# EasyEDA Pro project ProProject_Avaota Pi A_2024-03-25.epro, board PCB1 (continued)
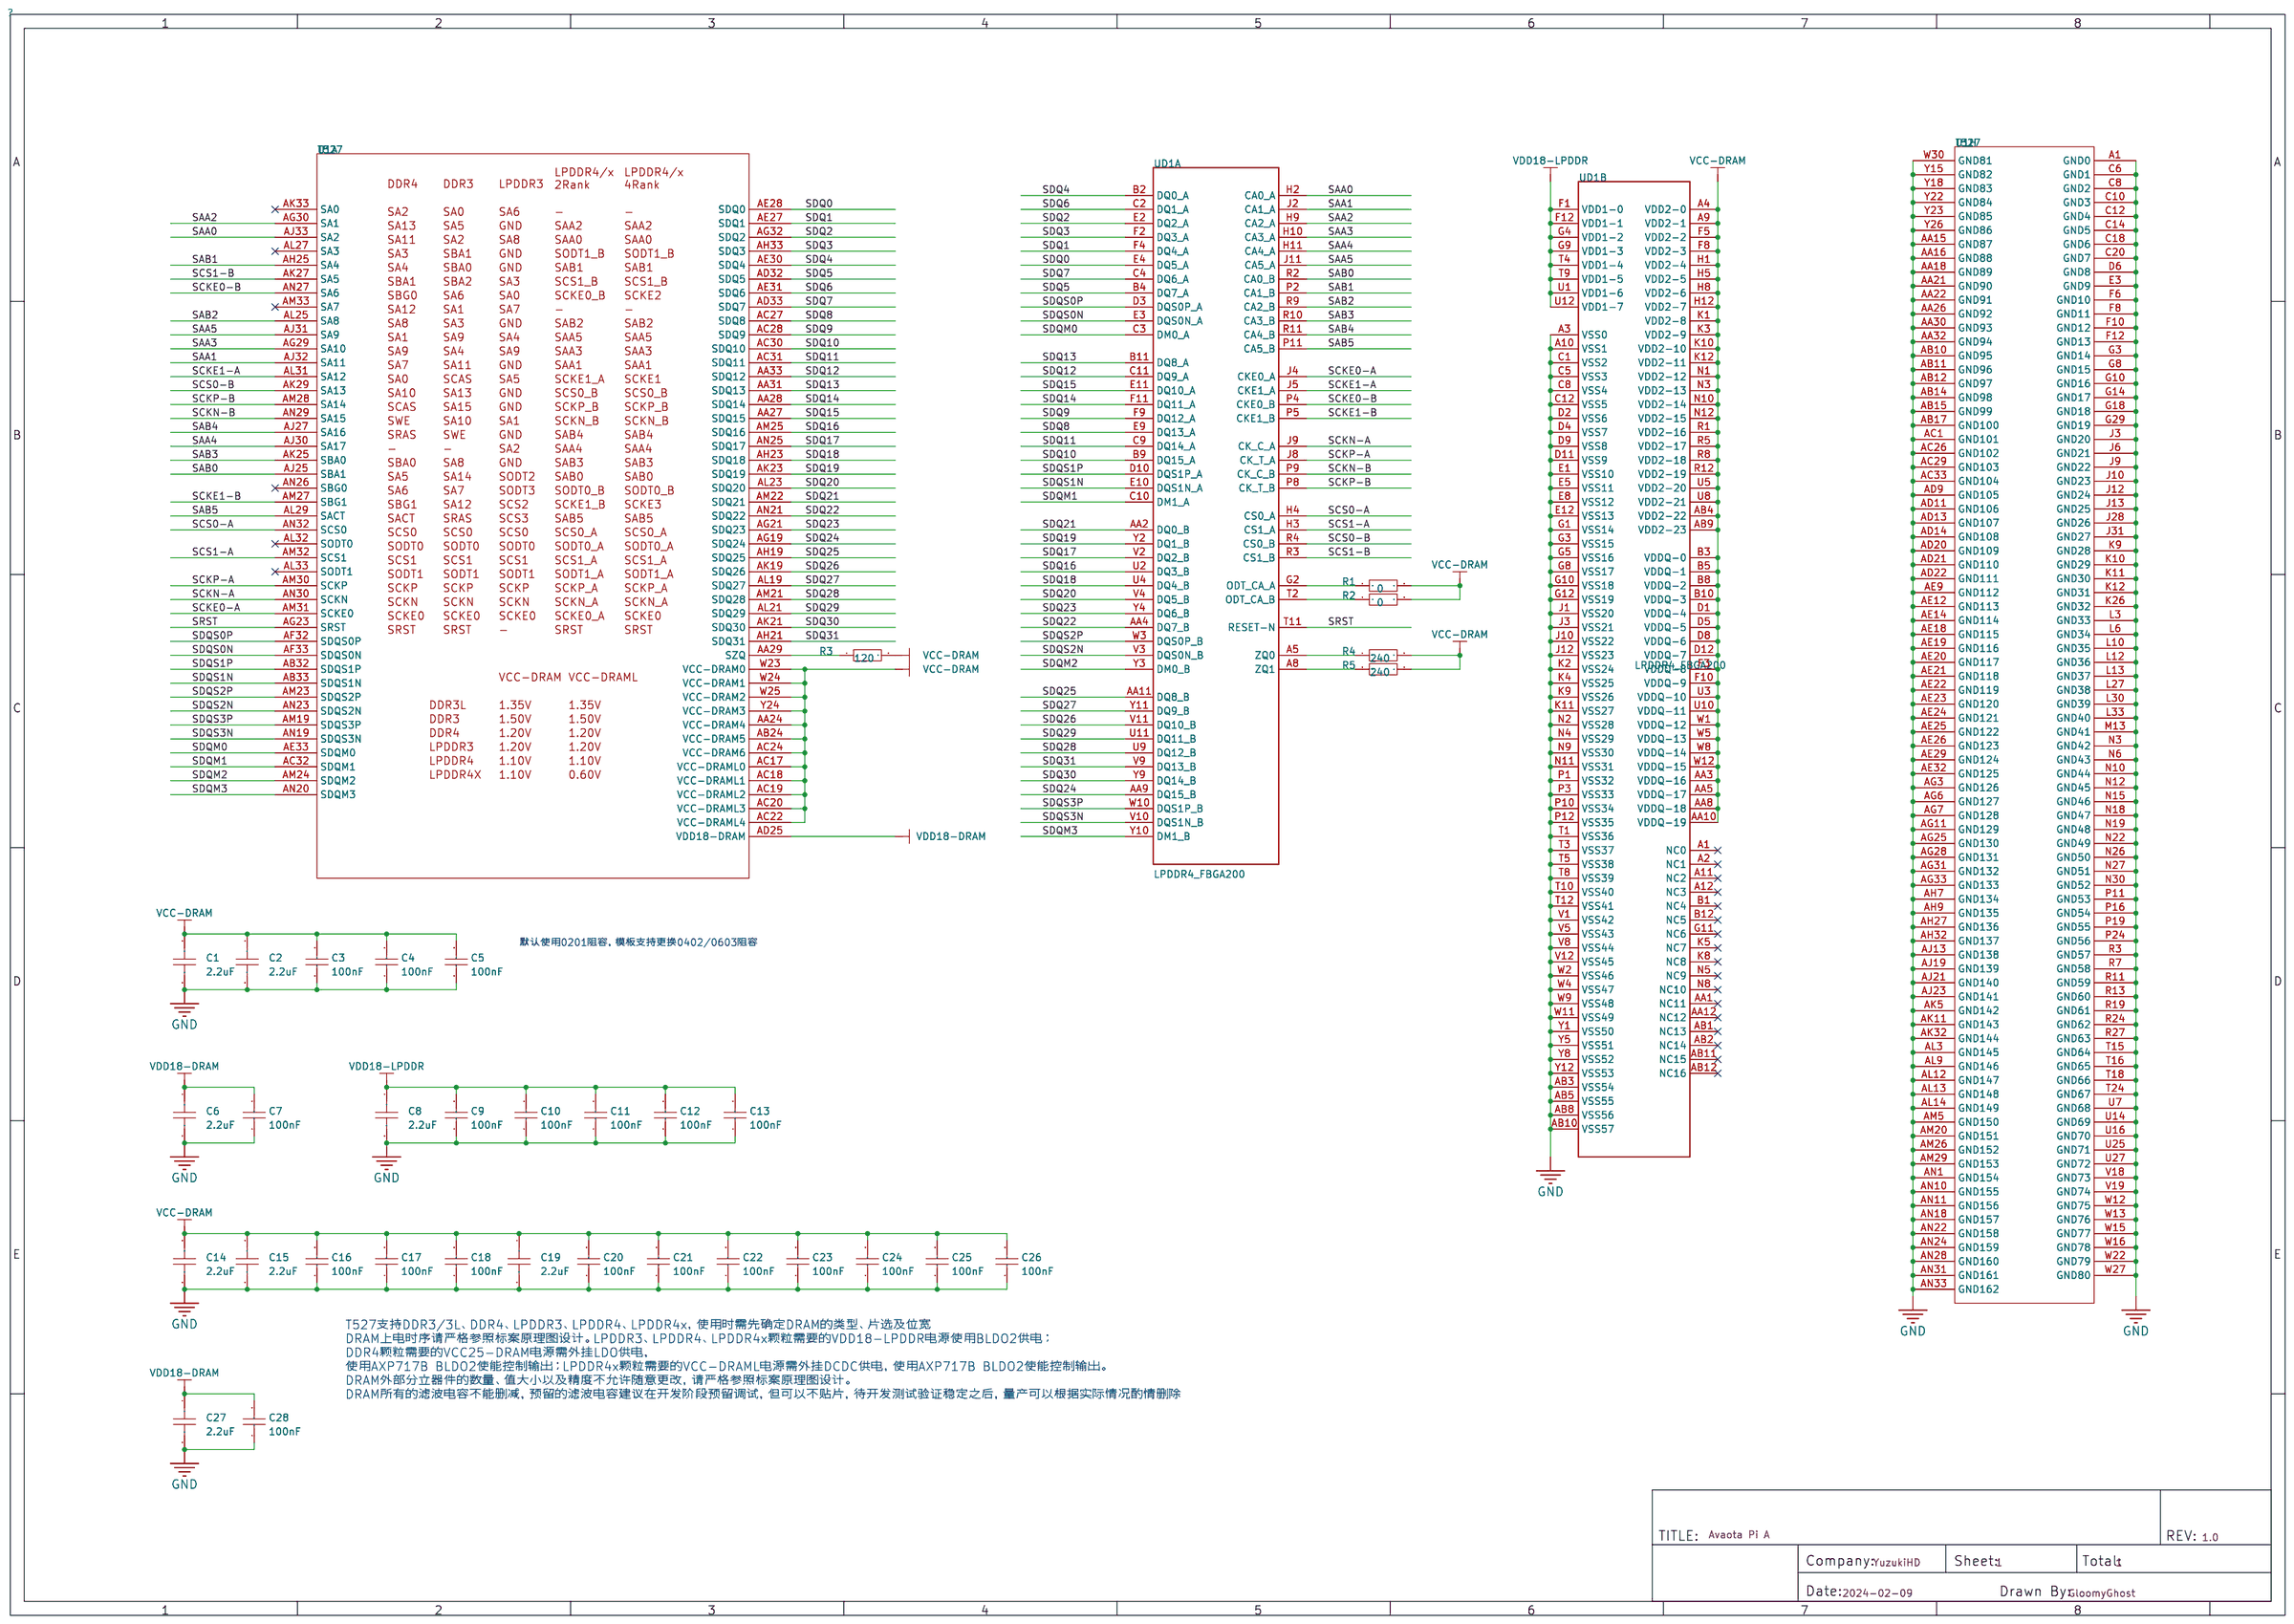
[diagram p0: schematic sheet]
## Routing (per net, layer and track width the routed paths; a pad name or vN(x,y) marks a point on that pad's centre or on a via; arc(x,y) is an arc through that point) (continued)
  Top Layer w0.127: TFT1.5 92.2,44.9 91.57,45.54 v1(91.57,46.18)
  内层2 w0.127: v1(48.72,62.69) 48.72,64.41 50.09,65.79 52.58,65.79 57.51,60.86 63.32,60.86 64.29,61.82 65.46,61.82 65.81,62.18 88.62,62.18 91.03,59.77 91.03,53.21 91.77,52.48 91.77,50.52 90.58,49.33 90.58,47.47 91.57,46.48 v1(91.57,46.18)
  Bottom Layer w0.076: 53.52,53.67 54,53.67 54.28,53.95 54.64,53.95 v2(54.97,53.62)
  Bottom Layer w0.102: 53.52,53.67 51.82,55.37 51.82,55.93 50.29,57.46 50.29,58.9 49.05,60.15 49.05,61.21 48.72,61.54 v1(48.72,62.69) 48.72,68.07 49,68.35 49.48,68.35 50.52,69.39 51.84,69.39 52.43,69.98 52.43,72.06 52.88,72.52 52.91,72.52 H1.38
SPI-LCD-MOSI: length 91.5
  Top Layer w0.102: v2(54.46,53.62) 54.47,53.62 U14.AK7
  Top Layer w0.127: TFT1.3 93.6,45.1 v1(91.62,47.09)
  内层2 w0.127: v1(91.62,47.09) 91.01,47.7 91.01,49.1 92.18,50.27 92.18,52.78 91.49,53.47 91.49,59.92 88.85,62.56 65.61,62.56 65.3,62.26 64.11,62.26 63.04,61.19 57.66,61.19 52.73,66.12 49.89,66.12 48.34,64.57 48.34,63.2 v1(48.21,63.07)
  Bottom Layer w0.102: v2(54.46,53.62) 54.1,53.26 53.49,53.26 52.81,53.95 52.65,53.95 51.49,55.12 51.49,55.73 49.94,57.28 49.94,58.8 48.72,60.02 48.72,61.06 48.21,61.57 v1(48.21,63.07) 48.21,68.43 48.64,68.86 49.23,68.86 51.05,70.69 51.08,70.69
SPI-LCD-RST: length 95
  Top Layer w0.076: v2(52.45,52.25) 52.96,52.25 53.31,51.89 53.69,51.89 U14.AM9
  Top Layer w0.127: TFT1.6 91.52,42.37 v1(91.52,44.86)
  内层2 w0.127: v1(46.35,64.74) 46.35,65.05 48.89,67.59 53.59,67.59 58.55,62.64 61.77,62.64 62.99,63.86 63.75,63.86 64.06,64.16 64.67,64.16 64.77,64.06 89.71,64.06 93.37,60.4 93.37,47.75 92.86,47.24 92.86,45.21 92.35,44.7 91.67,44.7 v1(91.52,44.86)
  Bottom Layer w0.102: 46,70.69 46.35,70.33 v1(46.35,64.74) 46.35,61.24 47.55,60.05 47.55,59.36 48.62,58.29 48.62,56.72 50.24,55.09 50.24,54.46 v2(52.45,52.25)
SRST: length 27.9
  Top Layer w0.076: v3(56.56,44.66) 56.54,44.68 56.54,44.76 56.43,44.87 56.43,45.14
  Top Layer w0.102: v3(34.63,50.27) 34.62,50.25 34.61,50.25 34.59,50.24 34.4,50.24 34.21,50.05
  内层2 w0.115: v3(34.63,50.27) 35.27,50.9 36.75,50.9 37.36,50.29 38.45,50.29 38.89,50.72 39.85,50.72 40,50.57 40.46,50.57 40.71,50.83 41.93,50.83 42.24,50.52 42.24,50.29 44.22,48.31 44.77,48.31 45.59,47.49 45.59,47.02 45.31,46.74 45.31,46.33 45.54,46.1 45.97,46.1 47.22,44.86 52.17,44.86 52.7,44.32 56.22,44.32 v3(56.56,44.66)
STWI1-SCK: length 27.6
  Top Layer w0.076: 53.92,54.63 53.69,54.4 52.54,54.4 51.99,54.94 51.99,55.85 51.26,56.59
  Top Layer w0.102: 51.26,56.59 50.67,57.18 47.17,57.18 v1(46.86,57.48)
  Bottom Layer w0.102: 41.92,72.21 42.24,71.88 42.24,70.13 43.18,69.19 43.18,67.06 45.54,64.69 45.54,60.88 46.76,59.66 46.76,57.58 v1(46.86,57.48) ; 41.92,72.21 41.92,72.23 H1.28 ; 41.92,72.21 41.63,72.49
STWI1-SDA: length 22.9
  Top Layer w0.076: 53.69,54.89 52.7,54.89
  Top Layer w0.102: U14.AM3 53.69,54.89 ; 52.7,54.89 52.32,55.27 52.32,56.06 50.9,57.48 47.68,57.48 v1(47.32,57.84)
  Bottom Layer w0.102: v1(47.32,57.84) 47.19,57.96 47.19,59.77 45.9,61.06 45.9,64.77 43.51,67.16 43.51,70.64 43.46,70.69
UART1-CTS: length 54.7
  Top Layer w0.076: v2(19.66,61.21) 19.43,61.44 19.43,65.74 19.74,66.04 U9.41
  Top Layer w0.102: v2(61.95,53.65) U14.U6
  Inner5 w0.102: v2(19.66,61.21) 21.84,63.4 45.26,63.4 49.2,59.46 55.25,59.46 56.59,58.12 58.17,58.12 61.04,55.25 62.2,55.25 62.56,54.89 62.56,54.26 v2(61.95,53.65)
UART1-RTS: length 57.3
  Top Layer w0.076: U9.44 17.04,66.04 17.5,65.58 17.7,65.58 18.34,64.95 18.34,62.28 17.51,61.45 17.51,61.16 17.73,60.93 18.75,60.93 v2(19.05,61.24)
  Top Layer w0.102: v2(62.95,54.65) U14.R4
  Inner5 w0.102: v2(62.95,54.65) 62.95,54.93 62.36,55.52 61.19,55.52 58.32,58.39 56.69,58.39 55.32,59.77 49.3,59.77 45.34,63.73 21.54,63.73 v2(19.05,61.24)
UART1-RX: length 56.7
  Top Layer w0.076: U9.42 19.05,66.16 19.05,61.85 v2(18.49,61.29)
  Top Layer w0.102: v2(62.95,54.15) U14.R5
  Inner5 w0.102: v2(18.49,61.29) 21.26,64.06 45.44,64.06 49.35,60.15 55.35,60.15 56.82,58.67 58.45,58.67 61.32,55.8 62.59,55.8 63.3,55.09 63.3,54.49 v2(62.95,54.15)
UART1-TX: length 58.8
  Top Layer w0.076: v2(17.91,61.32) 18.72,62.13 18.72,65.08 17.94,65.86 U9.43
  Top Layer w0.102: U14.R6 v2(62.95,53.65)
  Inner5 w0.102: v2(62.95,53.65) 63.6,54.3 63.6,55.22 62.71,56.11 61.42,56.11 58.6,58.93 57.02,58.93 55.52,60.43 49.5,60.43 45.54,64.39 20.98,64.39 v2(17.91,61.32)
USB0-DM: length 37.7
  Top Layer w0.076: v2(75.23,44.45) 75.11,44.58 71.45,44.58 71.37,44.5 70.82,44.5 70.72,44.4 69.29,44.4 69.05,44.65 U14.B24
  Top Layer w0.127: USB3.A7 85.47,68.48 85.47,67.62 v2(85.34,67.49) 85.34,67.11 85.1,66.86 D26.2 85.55,66.28 85.55,65.2 v2(85.37,65.02) ; USB3.B7 86.4,67.58 v2(86.33,67.51)
  VCC w0.127: v2(85.37,65.02) 85.55,64.85 85.55,63.63 81.36,59.44 81.36,52.83 75.37,46.84 75.37,44.93 75.23,44.79 v2(75.23,44.45)
  Bottom Layer w0.127: v2(85.34,67.49) 86.31,67.49 v2(86.33,67.51)
USB0-DP: length 38.1
  Top Layer w0.076: v2(75.74,44.53) 75.43,44.84 71.33,44.84 71.17,44.68 70.69,44.68 70.61,44.6 69.7,44.6 69.66,44.65 U14.A24
  Top Layer w0.127: USB3.B6 84.9,69.33 85.09,69.52 85.72,69.52 85.9,69.35 USB3.A6 85.83,68.48 85.83,67.27 D25.2 85.78,66.41 85.78,65.2 v2(85.95,65.02)
  VCC w0.127: v2(85.95,65.02) 85.78,64.85 85.78,63.5 81.64,59.36 81.64,52.73 75.6,46.7 75.6,44.93 75.74,44.79 v2(75.74,44.53)
USB0-DRVVBUS: length 90
  Top Layer w0.076: 56.92,47.11 v1(56.92,46.99) 56.87,47.22 56.67,47.32 56.46,47.57 55.01,47.57 U14.AL17
  Top Layer w0.152: R118.2 94.72,64.52 U17.4 93.48,64.96 v1(93.32,65.13)
  内层2 w0.102: v1(43.56,57.63) 44.35,56.85 44.63,56.85 45.01,56.46 45.62,56.46 46.53,55.55 49.3,55.55 50.9,53.95 50.9,50.44 51.31,50.04 52.12,50.04 53.9,48.26 54.41,48.26 54.74,47.93 55.98,47.93 v1(56.92,46.99)
  内层4 w0.152: v1(93.32,65.13) 91.95,66.5 91.95,67.72 91.64,68.02 91.16,68.02 87.78,64.64 67.01,64.64 64.26,67.39 44.58,67.39 v1(42.09,64.9)
  Bottom Layer w0.102: v1(42.09,64.9) 43,63.98 43,59.11 43.69,58.42 43.69,57.76 v1(43.56,57.63)
USB0-VBUSDET: length 83.1
  Top Layer w0.076: U14.AK17 55.26,47.83 56.67,47.83 v1(56.92,47.57)
  Top Layer w0.102: R121.2 R120.1 91.5,68.22 91.36,68.08 v2(91.36,67.62)
  内层2 w0.102: v1(56.92,47.57) 56.26,48.23 54.86,48.23 54.56,48.54 53.97,48.54 52.22,50.29 51.46,50.29 51.18,50.57 51.18,54.15 49.5,55.83 46.74,55.83 45.72,56.85 45.16,56.85 44.78,57.23 44.63,57.23 v1(44.15,57.71)
  内层4 w0.152: v2(91.36,67.62) 87.99,64.24 66.7,64.24 64.01,66.93 44.7,66.93 v1(42.67,64.9)
  Bottom Layer w0.102: v1(42.67,64.9) 43.31,64.26 43.31,59.26 43.97,58.6 43.97,57.89 v1(44.15,57.71)
USB1-DM: length 99.4
  Top Layer w0.102: v2(67.44,45.15) U14.E24
  Top Layer w0.127: v2(32.54,17.15) 32.49,17.09 32.49,16.42 D13.4 D13.7 32.56,15.07 32.42,14.93 32.42,14.61 33.41,13.61 36.29,13.61 37.62,12.29 37.62,9.51 35.55,7.44 34.62,7.44 32.99,5.82 29.57,5.82 28.88,6.51 28.88,7.01 28.65,7.24 USB2.2
  Bottom Layer w0.127: v2(32.54,17.15) 32.41,17.02 32.41,15.11 31.85,14.55 28.11,14.55 26.71,15.96 26.71,19.82 35.03,28.14 44,28.14 47.02,31.17 66.52,31.17 71.32,35.97 71.32,42.62 69.9,44.04 69.15,44.04 68.39,44.8 67.79,44.8 v2(67.44,45.15)
USB1-DP: length 99.2
  Top Layer w0.102: U14.D24 v2(67.94,45.15)
  Top Layer w0.127: v2(32.03,17.15) 32.11,17.07 32.11,16.4 D13.5 D13.6 32.06,15.07 32.19,14.93 32.19,14.51 33.32,13.39 36.2,13.39 37.39,12.19 37.39,9.6 35.46,7.67 34.53,7.67 32.9,6.05 29.67,6.05 29.11,6.6 29.11,7.01 29.33,7.24 USB2.3
  Bottom Layer w0.127: v2(67.94,45.15) 68.21,45.15 68.33,45.03 68.49,45.03 69.24,44.27 69.96,44.27 71.53,42.71 71.53,35.85 66.64,30.96 47.14,30.96 44.09,27.91 35.13,27.91 26.94,19.72 26.94,16.05 28.18,14.81 31.75,14.81 32.18,15.24 32.18,15.47 32.06,15.6 31.79,15.6 31.66,15.73 31.66,15.86 31.79,15.98 32.06,15.98 32.18,16.11 32.18,16.24 32.06,16.36 31.79,16.36 31.66,16.49 31.66,16.62 31.79,16.74 32.06,16.74 32.18,16.87 32.18,16.99 v2(32.03,17.15)
USB2-DM: length 94.3
  Top Layer w0.102: U14.E22 v2(67.44,46.15)
  Top Layer w0.127: v2(24.41,14.2) 24.26,14.35 24.26,14.95 24.39,15.08 D14.7 D14.4 24.39,16.68 24.26,16.82 24.26,18.34 25.3,19.38 27.53,19.38 27.86,19.05 27.86,18.21 v2(27.69,18.03)
  Bottom Layer w0.127: v2(24.41,14.2) 24.41,13.94 24.27,13.8 24.27,13.73 24.84,13.16 25.52,13.16 26.14,12.54 26.14,11.51 26.97,10.68 26.97,10.09 27.32,9.73 28.63,9.73 28.93,10.03 28.93,10.24 28.73,10.44 USB2.11 ; v2(67.44,46.15) 67.79,45.8 68.39,45.8 69.59,44.6 70.13,44.6 71.98,42.75 71.98,39.83 74.02,37.8 74.02,34.93 76.25,32.7 76.25,31.42 75.23,30.4 47.76,30.4 44.38,27.03 35.52,27.03 34.39,25.9 34.21,25.9 34.03,25.72 34.03,25.54 33.85,25.36 33.67,25.36 33.49,25.18 33.49,25 33.31,24.82 33.13,24.82 32.95,24.64 32.95,24.46 32.77,24.28 32.59,24.28 32.41,24.1 32.41,23.92 32.24,23.75 32.06,23.75 31.88,23.57 31.88,23.39 31.7,23.21 31.52,23.21 31.34,23.03 31.34,22.85 31.16,22.67 30.98,22.67 30.8,22.49 30.8,22.31 30.62,22.13 30.44,22.13 30.26,21.95 30.26,21.77 30.08,21.59 29.9,21.59 29.72,21.41 29.72,21.23 29.54,21.05 29.36,21.05 29.18,20.87 29.18,20.69 29,20.51 28.82,20.51 28.64,20.33 28.64,20.15 28.46,19.97 28.28,19.97 28.1,19.79 28.1,19.61 27.86,19.37 27.86,18.21 v2(27.69,18.03)
USB2-DP: length 94.4
  Top Layer w0.102: U14.D22 v2(67.94,46.15)
  Top Layer w0.127: v2(28.35,18.03) 28.09,18.29 28.09,19.14 27.63,19.61 25.15,19.61 24.03,18.49 24.03,16.84 23.89,16.7 D14.6 23.89,15.08 24.03,14.95 24.03,14.32 v2(23.9,14.2)
  Bottom Layer w0.127: v2(67.94,46.15) 68.21,46.15 68.33,46.03 68.49,46.03 69.69,44.83 70.22,44.83 72.21,42.84 72.21,39.93 74.24,37.9 74.24,35.03 76.48,32.79 76.48,31.33 75.35,30.2 47.88,30.2 44.48,26.8 35.61,26.8 28.09,19.28 28.09,18.29 v2(28.35,18.03) ; v2(23.9,14.2) 23.9,13.94 24.04,13.8 24.04,13.64 24.75,12.93 25.43,12.93 25.91,12.45 25.91,11.41 26.74,10.58 26.74,9.99 27.23,9.5 28.72,9.5 29.16,9.94 29.16,10.24 29.41,10.49 29.98,10.49 USB2.12
USB2-RXN: length 84.2
  Top Layer w0.076: v2(72.31,45.47) 72.11,45.26 71.81,45.26 71.69,45.15 70.88,45.15 70.52,44.79 69.82,44.79 69.71,44.89 68.7,44.89 U14.C23
  Top Layer w0.127: v2(31.17,17.15) 31.04,17.02 31.04,16.79 31.15,16.68 D15.1 D15.10 31.15,15.08 31.01,14.95 31.01,14.55 32.16,13.41 32.16,12.24 32.46,11.94 USB2.14
  Bottom Layer w0.127: v2(31.17,17.15) 30.99,17.32 30.99,18.8 36.96,24.77 45.46,24.77 49.19,28.5 76.45,28.5 79.5,31.55 79.5,36.7 76.52,39.68 74.98,39.68 73.71,40.95 73.71,43.64 72.26,45.09 72.26,45.15 72.31,45.2 v2(72.31,45.47)
USB2-RXP: length 84.2
  Top Layer w0.076: v2(71.83,45.62) 71.55,45.34 70.76,45.34 70.38,44.95 69.9,44.95 69.77,45.09 69,45.09 U14.B23
  Top Layer w0.127: v2(30.63,17.15) 30.71,17.07 30.71,16.76 30.65,16.71 D15.2 D15.9 30.65,15.08 30.79,14.95 30.79,14.46 31.93,13.32 31.93,12.24 31.62,11.94 USB2.15
  Bottom Layer w0.127: v2(30.63,17.15) 30.78,17.3 30.78,17.66 30.66,17.79 30.33,17.79 30.2,17.92 30.2,18.04 30.33,18.17 30.66,18.17 30.78,18.3 30.78,18.92 36.86,24.99 45.36,24.99 49.1,28.73 76.35,28.73 79.27,31.65 79.27,36.6 76.43,39.45 74.89,39.45 73.48,40.85 73.48,43.58 71.83,45.23 v2(71.83,45.62)
USB2-TXN: length 76.6
  Top Layer w0.076: v2(71.3,46.05) 71.3,46 70.94,45.64 69.95,45.64 69.73,45.42 arc(69.52,45.32) 69.29,45.36 arc(69.11,45.48) 68.96,45.65
  Top Layer w0.127: C219.1 29.65,17.88 29.52,18.01 29.52,18.16 v2(29.64,18.29)
  Bottom Layer w0.127: v2(29.64,18.29) 29.49,18.44 29.49,18.85 36.3,25.66 44.81,25.66 48.44,29.29 75.74,29.29 78.56,32.11 78.56,36.44 76.24,38.76 74.57,38.76 72.87,40.46 72.87,43.13 71.16,44.84 71.16,45.62 71.3,45.76 v2(71.3,46.05)
USB2-TXP: length 76.6
  Top Layer w0.076: U14.A22 69.67,45.65 69.9,45.87 70.64,45.87 v2(70.79,46.03)
  Top Layer w0.127: v2(29.13,18.29) 29.24,18.19 29.24,17.89 C220.1
  Bottom Layer w0.127: v2(29.13,18.29) 29.26,18.42 29.26,18.95 29.49,19.18 29.49,19.46 29.62,19.59 29.9,19.59 30.03,19.72 30.03,19.99 30.16,20.12 30.44,20.12 30.57,20.25 30.57,20.53 30.7,20.66 30.97,20.66 31.1,20.79 31.1,21.07 31.23,21.2 31.51,21.2 31.64,21.33 31.64,21.61 31.77,21.74 32.05,21.74 32.18,21.87 32.18,22.15 32.31,22.28 32.59,22.28 32.72,22.41 32.72,22.69 32.85,22.82 33.13,22.82 33.26,22.95 33.26,23.23 33.39,23.36 33.67,23.36 36.2,25.89 44.72,25.89 48.37,29.54 75.67,29.54 78.33,32.21 78.33,36.35 76.15,38.53 74.48,38.53 72.64,40.37 72.64,43.03 70.93,44.74 70.93,45.62 70.79,45.76 v2(70.79,46.03)
VCM-ADC: length 0.6
  Bottom Layer w0.203: v1(59.94,52.15) 59.94,52.22 59.72,52.45 59.72,52.63 C112.2
VRA1: length 1
  Top Layer w0.152: v2(56.92,54.15) U14.AG5
  Bottom Layer w0.152: v2(56.92,54.15) 57.36,54.15 C109.2
VRA2: length 1
  Top Layer w0.152: U14.AG4 v2(56.92,54.65)
  Bottom Layer w0.152: v2(56.92,54.65) 57.42,54.65 C110.2
VREFP-ADC: length 1.3
  Bottom Layer w0.102: R24.1 59.37,52.08 v2(59.44,52.15)
  Bottom Layer w0.203: C113.2 59.44,52.19 v2(59.44,52.15)
VRP: length 1
  Bottom Layer w0.178: C111.2 58.52,53.22 v2(58.44,53.15)
WL-REG-ON: length 55.3
  Top Layer w0.076: 61.5,57.91 61.41,57.7 61.39,57.32 61.43,56.95 61.51,56.6 61.52,56.44 61.68,56.27 61.68,56 61.44,55.75 61.44,55.64
  Top Layer w0.102: v2(18.44,53.77) 18.97,53.77 20.78,51.97 27.69,51.97 34.75,59.03 54.61,59.03 56.36,60.78 61.39,60.78 62.05,60.12 62.05,58.6 61.75,58.29 61.5,57.88 ; 17.06,54.76 17.3,54.53 17.3,53.95 v2(17.48,53.77)
  Bottom Layer w0.102: v2(18.44,53.77) v2(17.48,53.77)
WL-WAKE-AP: length 53.7
  Top Layer w0.076: 61.46,58.36 61.19,57.81 61.14,57.35 61.18,56.84 61.35,56.47 61.37,56.22 61.44,56.14 61.44,56.14
  Top Layer w0.102: 61.47,58.34 61.77,58.65 61.77,59.92 61.21,60.48 56.49,60.48 54.74,58.73 34.98,58.73 27.91,51.66 20.55,51.66 18.85,53.37 18.26,53.37 17.96,53.66 17.96,54.76
X32KIN: length 7.9
  Top Layer w0.102: U14.AM12 52.27,50.65 51.61,51.3 51.61,53.51 51.36,53.77 51.06,53.77 R25.1 50.91,52.89 ; 50.91,52.89 50.94,52.87 ; 50.91,52.89 50.66,52.89 50.4,52.63 X2.1
X32KOUT: length 8
  Top Layer w0.102: X2.2 50.35,55.18 50.62,54.91 C101.2 R25.2 51.02,53.99 51.41,53.99 51.84,53.56 51.84,51.4 52.38,50.87 53.67,50.87 U14.AM11
$1N3725: length 1.1
  Top Layer w0.152: U4.7 8.66,48.44 8.99,48.11 C43.1
$1N4703: length 2.7
  Top Layer w0.152: R13.2 4.23,55.72 4.8,55.14 5.02,55.14 5.24,54.92 6.09,54.92 U4.39
$1N4806: length 2.7
  Top Layer w0.152: U4.38 6.66,55.06 6.49,55.23 5.42,55.23 5.23,55.42 5.11,55.42 4.78,55.75 R14.2
$1N7320: length 0.8
  Top Layer w0.203: U5.8 14.2,43.01 C88.1
$1N42597: length 1.5
  Top Layer w0.152: LED1.1 16.55,50.82 R17.1
$2N1846: length 1.2
  Bottom Layer w0.127: R21.1 2.49,44.32 SW1.4
$2N1994: length 1.4
  Bottom Layer w0.152: R22.1 2.58,53.42 SW2.4
$2N2360: length 4.1
  Top Layer w0.076: 60.38,57.42 60.41,56.9 60.54,56.59 60.64,56.57 60.85,56.28 60.85,55.97 60.69,55.81 60.69,55.8 60.69,55.39 60.94,55.14
  Top Layer w0.102: R19.1 60.36,57.42 60.38,57.4
$2N2431: length 3.5
  Top Layer w0.076: 60.6,57.53 60.67,57.03 60.81,56.63 61.02,56.34 61.02,56.01 61.03,55.99 61.03,55.94 60.92,55.67
  Top Layer w0.102: R20.1 60.92,58.78 60.6,58.47 60.6,57.53
$2N7803: length 1.4
  Top Layer w0.152: SW3.4 1.97,65.05 R23.1
$3N7591: length 1.3
  Top Layer w0.115: 59.43,42.14 59.46,42.12 v3(59.9,42.12)
  Bottom Layer w0.152: 59.38,42.56 59.41,42.53 59.41,42.29 59.58,42.12 v3(59.9,42.12)
$3N7643: length 1.4
  Top Layer w0.115: v3(38.71,39.98) 39.01,40.28 39.01,40.3
  Bottom Layer w0.115: v3(38.71,39.98) 38.71,39.73 38.98,39.45 39.27,39.45
$3N7644: length 1.3
  Top Layer w0.115: v3(36.52,39.78) 36.61,39.86 36.61,40.3
  Bottom Layer w0.115: 36.43,40.45 36.43,39.87 v3(36.52,39.78)
$3N7648: length 3.5
  Top Layer w0.115: 43.61,43.01 43.34,43.01 43.23,43.12 43.23,44.07 42.8,44.5 41.71,44.5 41.41,44.2
$3N7649: length 3
  Top Layer w0.115: 41.41,50.05 41.7,49.76 43.43,49.76 43.66,49.99 44.15,49.99 44.19,50.03
$4N500: length 3.3
  Top Layer w0.076: 59.99,40.63 59.99,39.77 60.17,39.6 60.17,38.74 60.11,38.45
  Top Layer w0.102: R41.2 59.53,37.72 60.11,38.29 60.11,38.47
$4N609: length 4.5
  Top Layer w0.076: 68.44,47.14 68.69,46.89 70.44,46.89 70.76,47.22 71.62,47.22 71.75,47.09 72.48,47.09 R42.1
$4N713: length 3
  Top Layer w0.076: 62.44,56.14 62.46,56.17 62.54,56.87 62.52,56.91 62.46,57.5 62.46,57.52 ; 62.46,57.48 62.46,57.48
  Top Layer w0.102: R43.1 62.99,58.45 62.46,57.91 62.46,57.48
$5N3909: length 3.5
  Top Layer w0.076: 64.94,55.64 65.03,55.74 65.03,57.04 65.33,57.34 R123.2
$6N1044: length 1
  Top Layer w0.102: U14.G22 v2(66.44,46.15)
  Bottom Layer w0.152: v2(66.44,46.15) 66.44,45.69 R44.2
$6N1104: length 1
  Top Layer w0.102: v2(66.44,45.15) U14.G24
  Bottom Layer w0.152: R46.2 66.43,45.14 v2(66.44,45.15)
$6N1424: length 1.1
  Top Layer w0.102: U14.F28 v2(66.94,43.15)
  Bottom Layer w0.254: R55.2 66.62,43.47 v2(66.94,43.15)
$6N1887: length 3.3
  Top Layer w0.102: U14.G20 v2(66.44,47.18)
  Bottom Layer w0.102: R45.1 68.33,47.35 68.12,47.55 67.26,47.55 66.89,47.18 v2(66.44,47.18)
$6N1980: length 2.5
  Top Layer w0.102: U14.E20 v2(67.44,47.18)
  Bottom Layer w0.102: v2(67.44,47.18) 67.44,47.04 67.72,46.76 67.97,46.76 68.17,46.56 68.8,46.56 R49.2
$6N3848: length 0.9
  Top Layer w0.127: R47.2 D7.2
$6N3980: length 12.6
  Top Layer w0.102: D8.1 40.71,19.92 41.61,19.02 v2(41.61,18.82)
  Top Layer w0.127: D8.1 D8.10 40.71,21.84 R48.2
  Bottom Layer w0.102: v2(41.61,18.82) 41.88,19.1 42.52,19.1 44.83,16.79 44.83,14.96 44.27,14.4 44.27,13.67 43.54,12.94
$6N4130: length 7
  Top Layer w0.508: USB1.18 40.74,15.83 40.41,16.15 40.18,16.15 39.5,16.84 39.5,17.48 39.57,17.55 D9.1
$6N4341: length 10.6
  Top Layer w0.102: v2(42.09,18.69) 42.09,19 41.21,19.88 D8.2
  Top Layer w0.127: D8.2 D8.9 41.21,21.93 ; 41.21,21.93 R50.2 ; 41.21,21.93 41.21,21.94 R52.2
  Bottom Layer w0.102: USB1.15 44.53,15.08 44.53,16.61 42.44,18.69 v2(42.09,18.69)
$6N4352: length 8.5
  Top Layer w0.102: D8.4 42.21,19.95 42.47,19.69 42.47,17.07 42.63,16.91 arc(42.69,16.79) 42.72,16.66 arc(42.77,16.48) 42.88,16.33 arc(43.02,16.16) 43.13,15.98 arc(43.16,15.82) 43.13,15.67 arc(43.06,15.55) 42.98,15.44 arc(42.72,15.08) USB1.16
  Top Layer w0.127: 42.21,22.02 R51.2 ; 42.21,22.02 42.4,22.21 R53.2 ; 42.21,22.02 D8.7 D8.4
$6N4414: length 6.3
  Top Layer w0.102: D8.5 42.71,17.24 USB1.19
  Top Layer w0.127: R54.2 42.71,21.84 D8.6 D8.5
$6N5317: length 19.1
  Top Layer w0.127: 56.88,22.6 56.88,23.88 ; D10.1 56.84,23.9 C190.2 ; U15.1 53.93,7.68 54.66,8.41 54.66,8.77 57.63,11.74 57.63,21.49 56.72,22.4 56.72,22.46 56.86,22.6
$6N5400: length 18.1
  Top Layer w0.127: U15.3 54.55,8.98 57.4,11.84 57.4,21.39 56.49,22.3 56.49,22.46 56.36,22.6 D10.9 D10.2 56.36,24.76 C191.2
$6N5519: length 19.3
  Top Layer w0.127: 52.39,8.33 53.66,9.6 54.43,9.6 56.69,11.87 56.69,20.93 55.22,22.4 55.22,22.46 55.36,22.6 D10.7 D10.4 55.36,24.75 C192.2
$6N5561: length 20.1
  Top Layer w0.127: 52.39,9.63 52.39,9.18 52.5,9.07 52.73,9.07 53.16,9.5 53.16,10.52 53.54,10.9 54.18,10.9 54.51,10.57 55.07,10.57 56.46,11.96 56.46,20.83 54.99,22.3 54.99,22.46 54.86,22.6 D10.6 D10.5 54.86,24.76 C193.2
$6N5603: length 14.8
  Top Layer w0.127: U15.7 53.89,11.62 54.48,12.22 54.88,12.22 55.42,12.76 55.42,17.75 54.79,18.39 54.79,21.49 53.87,22.41 53.87,22.47 54,22.61 D11.10 D11.1 54,24.76 C194.2
$6N5645: length 14.3
  Top Layer w0.127: U15.9 54.05,12.88 54.48,12.45 54.79,12.45 55.19,12.85 55.19,17.66 54.56,18.29 54.56,21.39 53.64,22.31 53.64,22.47 53.5,22.61 D11.9 D11.2 53.5,24.76 C195.2
$6N5687: length 20.3
  Top Layer w0.127: 52.39,12.23 52.39,12.05 52.17,11.84 51.89,11.84 51.77,11.96 51.77,12.55 51.64,12.67 51.51,12.67 51.38,12.55 51.38,11.96 51.26,11.84 51.13,11.84 51,11.96 51,12.55 50.88,12.67 50.75,12.67 50.62,12.55 50.62,11.96 50.5,11.84 50.34,11.84 49.43,12.75 49.43,19.87 50.89,21.34 52.04,21.34 52.37,21.67 52.37,22.47 52.5,22.61 D11.7 D11.4 52.5,24.75 C196.2
$6N5729: length 20.4
  Top Layer w0.127: 52.39,13.53 52.39,13.25 53.06,12.57 53.06,11.91 52.73,11.58 50.24,11.58 49.2,12.62 49.2,19.96 50.8,21.56 51.94,21.56 52.14,21.76 52.14,22.47 52,22.61 D11.6 D11.5 52,24.76 C197.2
$6N6451: length 14.7
  Top Layer w0.127: v2(49.68,21.41) 49.68,21.42 49.5,21.6 49.5,22.47 49.64,22.6 D12.2 49.64,24.75 C199.2 49.69,24.8 R61.2
  Bottom Layer w0.127: v2(49.68,21.41) 49.68,21.15 49.53,21 49.53,16.69 50.29,15.93 51.51,15.93 51.66,16.08 51.66,16.51 51.94,16.79 52.76,16.79 53.89,17.92 U15.17
$6N6466: length 14.6
  Top Layer w0.127: R62.2 49.09,24.8 C198.2 49.14,24.75 D12.1 49.14,22.6 49.28,22.47 49.28,21.6 49.15,21.48 v2(49.15,21.41)
  Bottom Layer w0.127: v2(49.15,21.41) 49.15,21.15 49.28,21.02 49.28,16.62 50.2,15.7 51.56,15.7 51.79,15.47 52.7,15.47 53.89,16.65 53.89,16.78
$6N6553: length 1.2
  Bottom Layer w0.102: 52.39,14.83 52.38,14.82 R57.2
$6N6556: length 3.4
  Bottom Layer w0.102: U15.13 53.89,15.3 52.78,14.2 51.26,14.2 R56.2
$6N19248: length 8.5
  Top Layer w0.127: USB2.18 25.65,11.94 25.91,12.19 25.91,12.85 27.03,13.97 28.73,13.97 29.28,14.53 29.28,14.95 29.15,15.08 D15.6 29.15,17.17 C220.2
$6N19249: length 8.5
  Top Layer w0.127: USB2.17 26.39,11.94 26.14,12.19 26.14,12.76 27.12,13.74 28.82,13.74 29.51,14.43 29.51,14.95 29.65,15.08 D15.7 D15.4 29.65,17.2
$6N30377: length 1.2
  Top Layer w0.152: R117.1 91.57,64.56 U17.3
$8N2040: length 3.5
  Bottom Layer w0.102: 92.81,52.88 92.81,52.05 D16.1 91.4,50.83 90.68,50.83
$8N6741: length 2.6
  Top Layer w0.254: LED2.1 4.45,17.02 LED3.3
$8N6795: length 2.6
  Top Layer w0.254: LED3.1 2.62,12.26 LED4.3
$8N6805: length 2.6
  Top Layer w0.254: LED5.3 4.45,11.12 LED4.1
$8N9148: length 1.8
  Bottom Layer w0.102: 86.82,47.76 86.79,47.73 R116.1 R115.2
$8N11462: length 6.4
  Top Layer w0.254: 87.28,42.38 87.28,44.23 88.57,45.52 v1(90.02,45.52)
  Bottom Layer w0.254: R126.1 88.77,45.52 v1(90.02,45.52)
$10N1043: length 3.1
  Bottom Layer w0.508: C248.2 60.56,16.15 RJ1.P1
$10N3488: length 7.9
  Top Layer w0.152: R79.2 57.56,5.25 57.56,4.34 59.08,2.82 61.8,2.82 RJ1.12
$10N3497: length 15.6
  Top Layer w0.152: R80.1 57.99,5.36 57.86,5.23 57.86,4.47 59.23,3.1 61.95,3.1 62.51,2.54 70.21,2.54 RJ1.13
$11N1789: length 3.3
  Bottom Layer w0.508: C255.2 78.85,16.1 RJ2.P1
$11N1876: length 8
  Top Layer w0.152: RJ2.12 80.32,2.54 77.06,2.54 76.12,3.48 76.12,5.03 75.96,5.2 R97.2
$11N1882: length 15.8
  Top Layer w0.152: 89.51,1.48 88.35,2.64 80.82,2.64 80.52,2.95 77.04,2.95 76.4,3.58 76.4,5.03 76.56,5.19 R98.1
$12N673: length 3.6
  Top Layer w0.254: Q1.1 19.36,21.9 R1.1 20.62,22.28 20.62,22.27
$12N750: length 4.9
  Top Layer w0.254: DC1.5 7.67,6.26 C3.2
$12N1163: length 3.8
  Top Layer w0.254: U3.1 10.72,29.74 10.59,29.62 9.42,29.62 8.53,28.73 C4.1
$12N1491: length 1.6
  Top Layer w0.508: C8.2 14.9,30.39 U3.4
$12N1559: length 2.7
  Top Layer w0.254: C4.2 8.56,29.62 8.56,30.27 D4.2
$12N1618: length 3.7
  Top Layer w0.254: C10.1 C9.1 11.58,38.1 12.14,37.54 12.5,37.54 13.26,36.78 U3.6
$12N1697: length 0.9
  Top Layer w0.254: C9.2 11.56,39.95 R7.1
$12N1966: length 0.9
  Top Layer w0.254: R3.1 13.43,38.13 R5.2
$12N2016: length 4.4
  Top Layer w0.254: 12.47,39.07 R5.1 12.98,37.57 14.27,37.57 14.53,37.31 U3.5
$12N2052: length 4.3
  Top Layer w0.254: U3.3 13.28,30.73 13.28,29.57 13.52,29.33 R6.2 15.27,28.35 R4.1
$12N3300: length 6.1
  Top Layer w0.508: D1.1 17.88,32.06 19.23,32.06 19.84,31.45 19.84,30.28 19.41,29.85 CN1.1
$13N975: length 1.7
  Top Layer w0.127: RF1.1 9.91,64.17 C245.2 R72.2
$13N1231: length 1.3
  Bottom Layer w0.102: U11.8 95.02,18.59 94.56,19.05 94.27,19.05 R76.1
$13N1378: length 0.5
  Top Layer w0.254: R77.1 94.47,20.21 94.47,20.21
$13N1478: length 6.7
  Top Layer w0.254: R77.2 93.96,21.09 94.77,21.9 CN3.1 95.4,21.9 v1(96.27,21.03)
  Bottom Layer w0.254: v1(96.27,21.03) 97,20.29 97,19.58 96.29,18.87 96.29,18.32
$13N1485: length 9.5
  Top Layer w0.254: R78.2 94.88,21.11 95.35,21.11 95.88,20.57 96.52,20.57 96.8,20.85 v1(96.8,21.34) 96.77,21.34 96.27,21.84 96.27,22.45 95.56,23.16 CN3.2
  Bottom Layer w0.254: v1(96.8,21.34) 97.56,20.57 U11.6
$13N1600: length 0.5
  Bottom Layer w0.127: 70.49,69.09 70.49,68.58 70.5,68.57
$13N1603: length 0.5
  Bottom Layer w0.127: R66.1 C241.2
$13N2020: length 0.7
  Bottom Layer w0.254: R67.2 67.02,68.57 67.12,68.68
$13N2077: length 0.7
  Bottom Layer w0.254: R68.2 67.02,69.66 C243.2
$13N5258: length 1
  Top Layer w0.254: CGQ1.4 95.5,16.66 R125.1

## Copper pours and planes (outline as drawn; the poured copper is in the pictures)
GND on Top Layer: -8.84,81.31 106.93,81.31 106.93,-10.13 -8.84,-10.13
GND on Bottom Layer: -7.04,79.76 108.74,79.76 108.74,-11.68 -7.04,-11.68
GND on GND1: -8.17,81.08 107.6,81.08 107.6,-10.36 -8.17,-10.36
GND on GND1: 60.53,45.47 59.1,45.47 58.8,45.77 58.8,48.21 57.99,49.02 51.81,49.02 45.36,55.47 32.43,55.47 31.93,54.97 31.93,39.5 34.87,36.55 59.15,36.55 60.81,38.2 60.81,45.19
GND on GND1: 60.53,45.49 59.1,45.49 58.8,45.8 58.8,48.24 57.98,49.05 51.81,49.05 45.36,55.5 32.43,55.5 31.92,54.99 31.92,39.52 34.87,36.58 59.15,36.58 60.8,38.23 60.8,45.21
GND on 内层2: -7.99,80.77 107.79,80.77 107.79,-10.67 -7.99,-10.67
GND on VCC: 60.54,45.48 59.12,45.48 58.81,45.78 58.81,48.22 58,49.03 51.83,49.03 45.38,55.49 32.45,55.49 31.94,54.98 31.94,39.51 34.88,36.56 59.17,36.56 60.82,38.21 60.82,45.2
GND on VCC: -7.85,80.62 107.92,80.62 107.92,-10.82 -7.85,-10.82
GND on 内层4: -7.65,80.39 108.13,80.39 108.13,-11.05 -7.65,-11.05
GND on Inner5: -7.48,80.2 108.29,80.2 108.29,-11.24 -7.48,-11.24
GND on GND2: -7.29,80.01 108.48,80.01 108.48,-11.43 -7.29,-11.43
